# EasyEDA Pro project 小键盘示例板.eprj, board 1x4+5_rgb
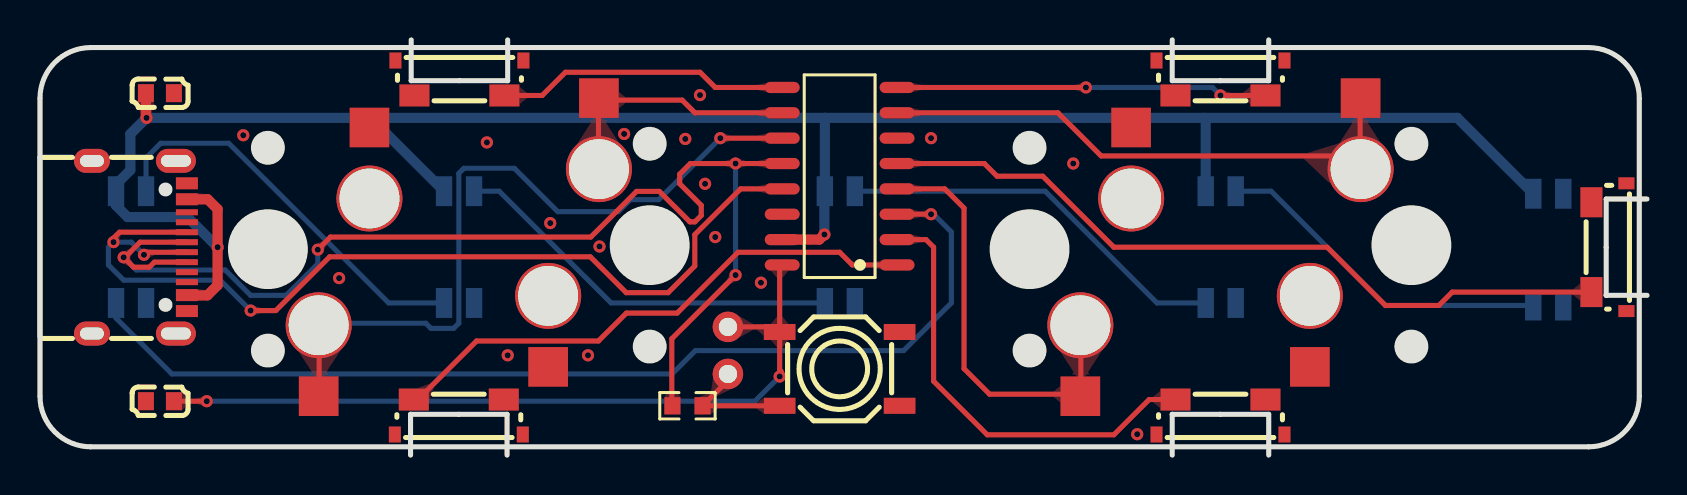
[diagram p11: board, top side]
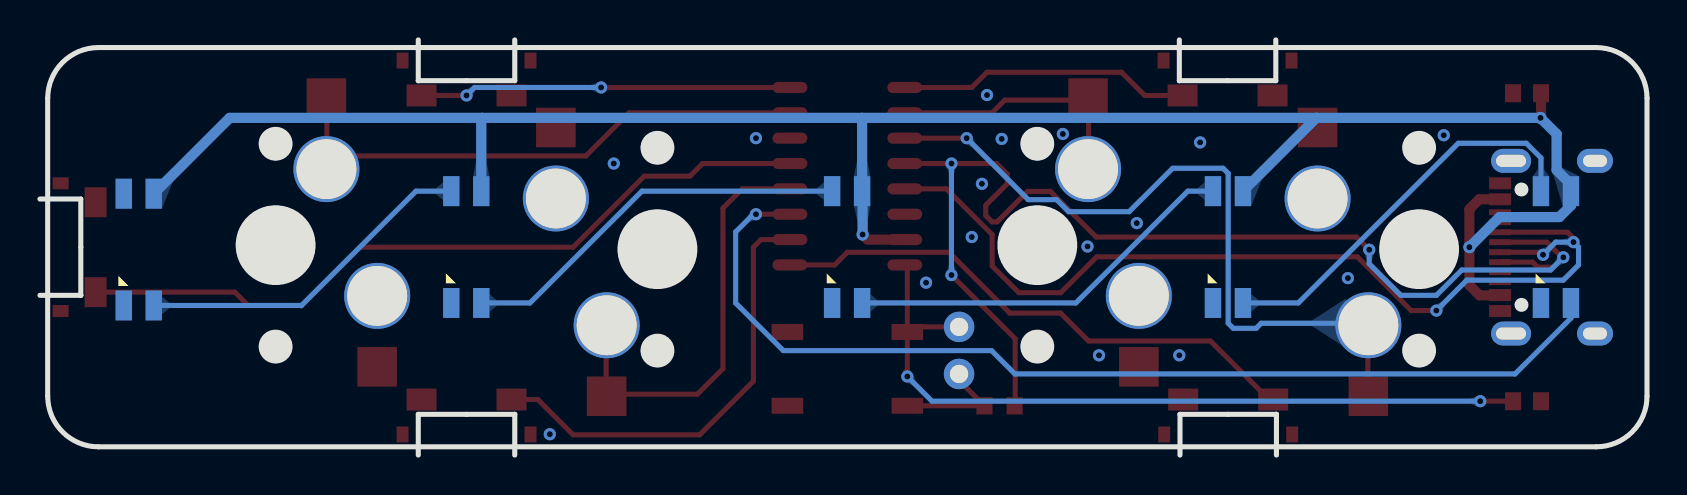
[diagram p12: board, bottom side, seen from below]

Outline 80.39 x 20.8 mm; copper layers: Top Layer, Bottom Layer. Coordinates in mm from the lower left corner of the outline.
Outline path: 0,17.87 arc(0.74,19.67) 2.54,20.41 77.46,20.41 arc(79.26,19.67) 80,17.87 80,2.95 arc(79.26,1.16) 77.46,0.41 2.54,0.41 arc(0.74,1.16) 0,2.95 0,17.87
Stack: Top Layer 0.035mm / Dielectric1 1.51mm FR4 er 4.5 / Bottom Layer 0.035mm

## Design rules (mm)
spacing Default (default): track to track 0.152, other pairs 0 to 0.152
track width Default (default): min 0.254, default 0.305, max 25.4
differential pair differentialPair (default): width min 0.127, default 0.254, max 2.54; gap min 0.152, default 0.152
via Default (default): diameter min 0.61, default 0.61, max 100.025; hole min 0.305, default 0.305, max 59.995
net GND uses gge1415

## Placement (name value [footprint] x y rotation side)
C1  100nF  [C0603]  6 2.7 180 top
C2  100nF  [C0603]  6 18.13 180 top
KEY1  -  [热插拔轴座]  68.57 10.41 90 bottom
KEY2  -  [热插拔轴座]  49.53 10.41 270 bottom
KEY3  -  [热插拔轴座]  30.47 10.41 90 bottom
KEY4  -  [热插拔轴座]  11.42 10.41 270 bottom
NOREF  -  [Pad_e101]  34.41 6.42 90 top
NOREF#2  -  [Pad_e99]  34.41 4.06 90 top
R1  10K  [R0603]  32.39 2.47 0 top
SW  TS-1076S-A1B2  [SW-SMD_4P-L5.2-W5.2-P3.70-LS6.4]  40 4.32 180 top
SW2  TSA356G00-250  [SW-SMD_TSA356G00-250]  78.48 10.41 90 top
SW3  TSA356G00-250  [SW-SMD_TSA356G00-250]  59.05 18.89 180 top
SW4  TSA356G00-250  [SW-SMD_TSA356G00-250]  59.05 1.91 0 top
SW5  TSA356G00-250  [SW-SMD_TSA356G00-250]  20.98 18.89 180 top
SW6  TSA356G00-250  [SW-SMD_TSA356G00-250]  20.95 1.91 0 top
U1  CH552G  [SOP-16_L10.0-W3.9-P1.27-LS6.0-BL]  40 13.97 90 top
U2  TypeC-16PIN  [USB-C-SMD_TYPE-C-6PIN-2MD-073]  4.97 10.41 270 top
U3  -  [ws2812反贴灯上装不挖槽反捏]  4.54 10.41 270 top
U4  -  [ws2812反贴灯上装不挖槽反捏]  20.95 10.41 270 top
U5  -  [ws2812反贴灯上装不挖槽反捏]  40 10.41 270 top
U6  -  [ws2812反贴灯上装不挖槽反捏]  59.05 10.41 270 top
U7  -  [ws2812反贴灯上装不挖槽反捏]  75.43 10.29 270 top

## Footprints (pads in the part's own frame, mm; a bottom-side part is the same pattern mirrored in y, then rotated)
C0603
  rect 0.8x0.9 smd: 1(-0.7,0) 2(0.7,0)
Pad_e99
  round 1.524 hole 0.914: 1(0,0)
Pad_e101
  round 1.524 hole 0.914: 2(0,0)
R0603
  rect 0.806x0.864 smd: 1(-0.753,0) 2(0.753,0)
SOP-16_L10.0-W3.9-P1.27-LS6.0-BL
  oval 0.56x1.745 smd: 1(-4.445,-2.873) 2(-3.175,-2.873) 3(-1.905,-2.873) 4(-0.635,-2.873) 5(0.635,-2.873) 6(1.905,-2.873) 7(3.175,-2.873) 8(4.445,-2.873) 9(4.445,2.873) 10(3.175,2.873) 11(1.905,2.873) 12(0.635,2.873) 13(-0.635,2.873) 14(-1.905,2.873) 15(-3.175,2.873) 16(-4.445,2.873)
SW-SMD_4P-L5.2-W5.2-P3.70-LS6.4
  rect 1.58x0.8 smd: 1(-2.999,1.849) 2(2.999,1.849) 3(-2.999,-1.849) 4(2.999,-1.849)
SW-SMD_TSA356G00-250
  rect 1.501x1.1 smd: 1(-2.251,0.876) 2(2.251,0.876)
  rect 0.6x0.8 smd: 3(-3.2,-0.874) 4(3.2,-0.874)
USB-C-SMD_TYPE-C-6PIN-2MD-073
  rect 0.6x1.1 smd: 1(-3.2,2.375) 2(-2.4,2.375) 11(2.4,2.375) 12(3.2,2.375)
  rect 0.3x1.1 smd: 3(-1.75,2.375) 4(-1.25,2.375) 5(-0.75,2.375) 6(-0.25,2.375) 7(0.25,2.375) 8(0.75,2.375) 9(1.25,2.375) 10(1.75,2.375)
  oval 1.2x2 hole 0.6x1.5: 13(-4.325,1.825) 14(4.325,1.825)
  oval 1.2x1.8 hole 0.6x1.2: 13(-4.325,-2.375) 14(4.325,-2.375)
ws2812反贴灯上装不挖槽反捏
  rect 1.5x0.82 smd far side: 1(2.794,0.762) 2(2.794,-0.738) 3(-2.806,-0.738) 4(-2.806,0.762)
热插拔轴座
  rect 1.981x1.981 smd far side: 1(-5.995,-5.056) 2(7.466,-2.515)
  round 3.304 hole 3: 1(-2.439,-5.056) 2(3.91,-2.515)

## Nets
As in the schematic, except:
3.3V: C1.1 NOREF.2 SW.4 U1.16
RST: NOREF#2.1 R1.2 SW.2

Pads without a net: SW 1 3; U1 6; U2 3 4 9 10; U7 4

## Via types
v1: diameter 0.61, hole 0.305, Top Layer to Bottom Layer, 32 vias

## Routing (per net, layer and track width the routed paths; a pad name or vN(x,y) marks a point on that pad's centre or on a via; arc(x,y) is an arc through that point)
3.3V: length 38.9
  Top Layer w0.254: 37.08,4.19 37,4.27 SW.4 ; SW.4 36.75,6.42 NOREF.2 ; SW.4 37,9.4 37.13,9.53 ; C1.1 v1(8.34,2.7)
  Bottom Layer w0.254: v1(37,3.94) 35.76,2.7 v1(8.34,2.7)
GND:
  vias: v1(10.17,16.02) v1(14.96,8.86) v1(22.35,15.66) v1(23.4,5) v1(25.52,11.62) v1(27.41,5) v1(27.99,10.45) v1(29.22,16.09) v1(32.28,15.84) v1(33.01,18.03) v1(33.27,13.59) v1(33.78,10.92) v1(36.06,8.64) v1(44.57,15.88) v1(51.68,14.61) v1(54.88,1.05)
VCC: length 107.4
  Top Layer w0.508: U1.15 38.98,10.8 v1(39.24,11.05) ; C2.2 5.3,16.92 v1(5.33,16.89) ; U2.11 7.36,8 8.38,8 8.89,8.51 v1(8.89,10.41) 8.89,12.32 8.39,12.81 U2.2
  Bottom Layer w0.508: 58.27,16.89 70.9,16.89 U7.3 ; 58.27,16.89 58.31,16.85 U6.3 ; 58.27,16.89 39.26,16.89 ; 39.26,16.89 16.54,16.89 ; 39.26,16.89 39.26,16.89 U5.3 39.24,13.2 v1(39.24,11.05) ; 16.54,16.89 U4.3 ; 16.54,16.89 v1(5.33,16.89) 4.52,16.08 4.52,14.28 3.81,13.56 U3.3 3.81,12.5 4.38,11.92 7.38,11.92 v1(8.89,10.41)
DM: length 48.8
  Top Layer w0.254: U1.13 35.05,13.34 32.75,11.04 32.75,9.47 31.42,8.13 29.33,8.13 27.53,9.93 14.49,9.93 11.8,7.24 v1(10.54,7.24) ; U2.7 7.35,10.16 5.33,10.16 v1(5.2,10.03) ; 3.68,10.67 3.68,10.87 3.98,11.16 U2.5
  Bottom Layer w0.254: v1(10.54,7.24) 9.01,8.76 4.19,8.76 3.42,9.53 3.42,10.41 v1(3.68,10.67) 4.57,10.67 v1(5.2,10.03)
DP: length 61.3
  Top Layer w0.254: v1(13.9,10.29) 14.53,10.92 27.55,10.92 29.84,13.21 30.98,13.21 32.51,11.68 32.76,11.68 33.08,12 33.08,12.51 32,13.59 32,14.07 32.53,14.61 v1(34.79,14.61) U1.12 ; U2.6 5.01,10.66 4.25,9.91 v1(4.19,9.91) 4.68,9.41 5.47,9.41 5.72,9.66 U2.8 ; v1(34.79,9.02) 31.6,5.83 31.6,2.56 31.51,2.47
  Bottom Layer w0.254: v1(13.9,10.29) 13.9,9.58 12.31,8 10.54,8 9.27,9.27 4.82,9.27 v1(4.19,9.91) ; v1(34.79,9.02) v1(34.79,14.61)
K1: length 28
  Top Layer w0.254: U1.7 50.92,17.14 53.08,14.99 65.27,14.99 66.03,14.22 66.03,17.78 65.95,17.78
K2: length 21.7
  Top Layer w0.254: U1.4 45.26,13.34 46.22,12.37 46.22,4.33 47.5,3.05 52.06,3.05 52.06,6.6
K3: length 13
  Top Layer w0.254: U1.10 32.76,17.14 32.13,17.78 27.94,17.78 27.94,14.22
K4: length 37
  Top Layer w0.254: 13.97,6.6 13.97,3.05 ; v1(34.03,15.88) U1.11
  Bottom Layer w0.254: v1(34.03,15.88) 30.95,12.8 29.53,12.8 28.93,12.19 25.9,12.19 23.73,14.37 21.2,14.37 20.95,14.11 20.95,6.6 20.7,6.35 19.55,6.35 19.3,6.6 13.97,6.6
RGB: length 51.7
  Top Layer w0.254: U1.3 v1(44.57,12.06)
  Bottom Layer w0.254: U3.2 3.81,6.86 6.6,4.06 31.62,4.06 32.79,5.23 43.2,5.23 45.59,7.62 45.59,11.18 44.7,12.06
RST: length 6
  Top Layer w0.254: NOREF#2.1 34.41,3.74 R1.2 37,2.47
S2: length 38
  Top Layer w0.254: U1.5 47.24,14.61 47.87,13.97 50.16,13.97 53.72,10.41 64.38,10.41 67.31,7.49 69.97,7.49 70.64,8.16 SW2.1
S3: length 18.6
  Top Layer w0.254: U1.8 v1(52.32,18.42) ; v1(59.05,18.02) 61.3,18.02
  Bottom Layer w0.254: v1(59.05,18.02) 58.65,18.42 v1(52.32,18.42)
S4: length 22.6
  Top Layer w0.254: SW4.1 55.48,2.78 53.72,1.02 47.38,1.02 44.7,3.7 44.7,10.41 44.32,10.8 U1.2
S5: length 14.7
  Top Layer w0.254: 23.23,18.02 25.12,18.02 26.28,19.18 33.01,19.18 33.78,18.42 U1.9
S6: length 27.5
  Top Layer w0.254: SW6.1 18.91,2.78 21.84,5.72 27.94,5.72 29.33,7.11 31.87,7.11 34.92,10.16 40,10.16 40.63,9.53 42.87,9.53
$1N7262: length 20.2
  Bottom Layer w0.254: U4.2 17.44,7.62 9.44,15.62 6.04,15.62 5.31,14.89 U3.4
$1N7266: length 19.9
  Bottom Layer w0.254: U5.2 28.57,7.62 22.97,13.22 U4.4
$1N7270: length 19.9
  Bottom Layer w0.254: U5.4 50.28,13.22 55.88,7.62 U6.2
$1N9285: length 17.3
  Bottom Layer w0.254: U6.4 61.58,13.22 67.32,7.48 67.33,7.49 U7.2

## Copper pours and planes (outline as drawn; the poured copper is in the pictures)
GND on Top Layer: -3.6,24.62 81.87,24.62 81.87,-1.28 -3.6,-1.28
GND on Bottom Layer: -1.99,22.57 86.02,22.57 86.02,-2.33 -1.99,-2.33

Small or netless copper shapes (teardrops, artwork), in the pictures only: 62 on Top Layer, 30 on Bottom Layer

## Text on the board
Top Layer: 看着碍事拖动一下红色和蓝色框框铺铜就没了 / shift+b重新铺铜
